# EasyEDA Pro project EKOPARTY_FINAL.eprj, schematic Schematic1
Board Name: Board1; Create Date: 2025-08-02; Page Name: P1; Project Name: EKOPARTY_FINAL; Schematic Name: Schematic1; Update Date: 2025-10-07; Company: EasyEDA.com; Drawn: Lucas Leal; Page Size: A4; Reviewed: Lucas Leal; Version: V1.0
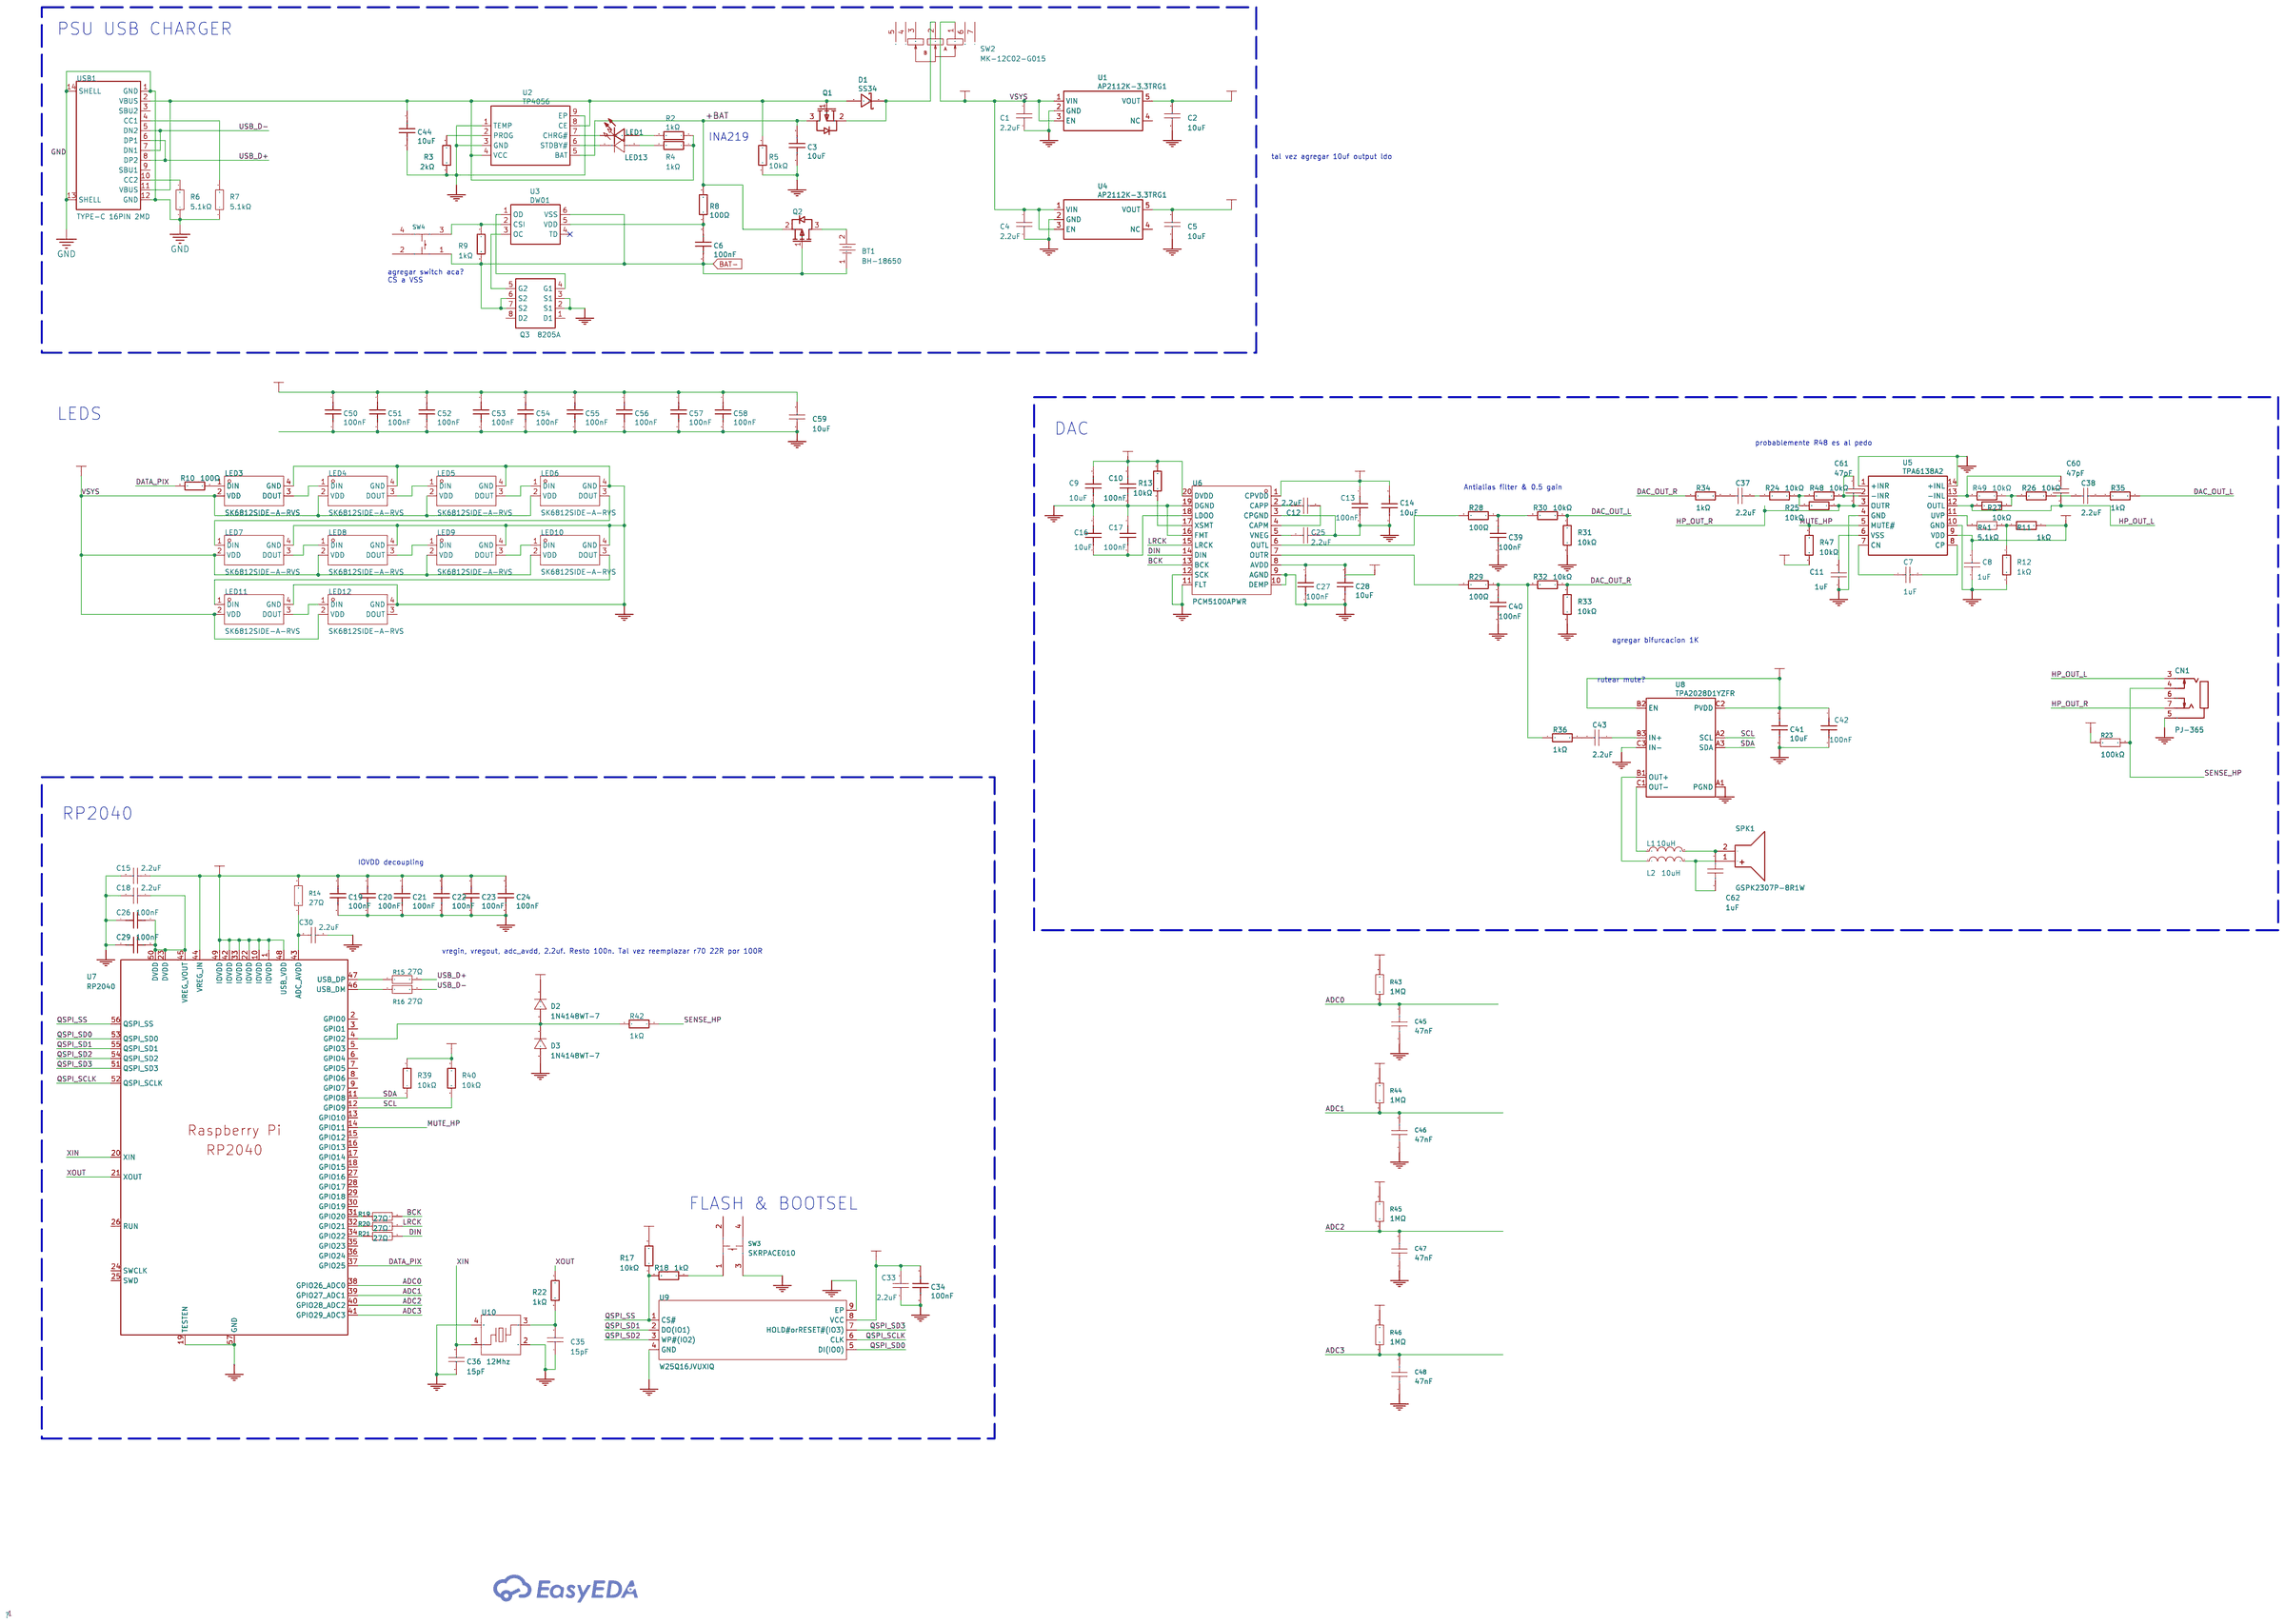
[diagram p0: schematic sheet]

## Parts
BT1  BH-18650  [BAT-TH_BH-18650-A1AJ005]
C1  2.2uF  [C0402]
C2  10uF  [C0402]
C3  10uF  [C0402]
C4  2.2uF  [C0402]
C5  10uF  [C0402]
C6  100nF  [C0402]
C7  1uF  [C0402]
C8  1uF  [C0402]
C9  10uF  [C0402]
C10  100nF  [C0402]
C11  1uF  [C0402]
C12  2.2uF  [C0402]
C13  100nF  [C0402]
C14  10uF  [C0402]
C15  2.2uF  [C0402]
C16  10uF  [C0402]
C17  100nF  [C0402]
C18  2.2uF  [C0402]
C19  100nF  [C0402]
C20  100nF  [C0402]
C21  100nF  [C0402]
C22  100nF  [C0402]
C23  100nF  [C0402]
C24  100nF  [C0402]
C25  2.2uF  [C0402]
C26  100nF  [C0402]
C27  100nF  [C0402]
C28  10uF  [C0402]
C29  100nF  [C0402]
C30  2.2uF  [C0402]
C33  2.2uF  [C0402]
C34  100nF  [C0402]
C35  15pF  [C0402]
C36  15pF  [C0402]
C37  2.2uF  [C0402]
C38  2.2uF  [C0402]
C39  100nF  [C0402]
C40  100nF  [C0402]
C41  10uF  [C0402]
C42  100nF  [C0402]
C43  2.2uF  [C0402]
C44  10uF  [C0402]
C45  47nF  [C0402]
C46  47nF  [C0402]
C47  47nF  [C0402]
C48  47nF  [C0402]
C50  100nF  [C0402]
C51  100nF  [C0402]
C52  100nF  [C0402]
C53  100nF  [C0402]
C54  100nF  [C0402]
C55  100nF  [C0402]
C56  100nF  [C0402]
C57  100nF  [C0402]
C58  100nF  [C0402]
C59  10uF  [C0402]
C60  47pF  [C0402]
C61  47pF  [C0402]
C62  1uF  [C0603]
CN1  PJ-365  [AUDIO-SMD_HOOYA_PJ-365]
D1  SS34  [SMA_L4.3-W2.6-LS5.2-RD]
D2  1N4148WT-7  [SOD-523_L1.2-W0.8-LS1.6-RD]
D3  1N4148WT-7  [SOD-523_L1.2-W0.8-LS1.6-RD]
L1  10uH  [L1206]
L2  10uH  [L1206]
LED1  KT-0603R  [LED0603-RD]
LED3  SK6812SIDE-A-RVS  [LED-SMD_4P-L4.0-W1.6-L]
LED4  SK6812SIDE-A-RVS  [LED-SMD_4P-L4.0-W1.6-L]
LED5  SK6812SIDE-A-RVS  [LED-SMD_4P-L4.0-W1.6-L]
LED6  SK6812SIDE-A-RVS  [LED-SMD_4P-L4.0-W1.6-L]
LED7  SK6812SIDE-A-RVS  [LED-SMD_4P-L4.0-W1.6-L]
LED8  SK6812SIDE-A-RVS  [LED-SMD_4P-L4.0-W1.6-L]
LED9  SK6812SIDE-A-RVS  [LED-SMD_4P-L4.0-W1.6-L]
LED10  SK6812SIDE-A-RVS  [LED-SMD_4P-L4.0-W1.6-L]
LED11  SK6812SIDE-A-RVS  [LED-SMD_4P-L4.0-W1.6-L]
LED12  SK6812SIDE-A-RVS  [LED-SMD_4P-L4.0-W1.6-L]
LED13  XL-1608UBC-04  [LED0603-RD_BLUE]
Q1  FDN340P  [SOT-23-3_L2.9-W1.3-P1.90-LS2.4-BR]
Q2  FDN340P  [SOT-23-3_L2.9-W1.3-P1.90-LS2.4-BR]
Q3  8205A  [TSSOP-8_L4.4-W3.0-P0.65-LS6.4-BL]
R2  1kΩ  [R0402]
R3  2kΩ  [R0402]
R4  1kΩ  [R0402]
R5  10kΩ  [R0402]
R6  5.1kΩ  [R0402]
R7  5.1kΩ  [R0402]
R8  100Ω  [R0402]
R9  1kΩ  [R0402]
R10  100Ω  [R0402]
R11  1kΩ  [R0402]
R12  1kΩ  [R0402]
R13  10kΩ  [R0402]
R14  27Ω  [R0402]
R15  27Ω  [R0402]
R16  27Ω  [R0402]
R17  10kΩ  [R0402]
R18  1kΩ  [R0402]
R19  27Ω  [R0402]
R20  27Ω  [R0402]
R21  27Ω  [R0402]
R22  1kΩ  [R0402]
R23  100kΩ  [R0402]
R24  10kΩ  [R0402]
R25  10kΩ  [R0402]
R26  10kΩ  [R0402]
R27  10kΩ  [R0402]
R28  100Ω  [R0402]
R29  100Ω  [R0402]
R30  10kΩ  [R0402]
R31  10kΩ  [R0402]
R32  10kΩ  [R0402]
R33  10kΩ  [R0402]
R34  1kΩ  [R0402]
R35  1kΩ  [R0402]
R36  1kΩ  [R0402]
R39  10kΩ  [R0402]
R40  10kΩ  [R0402]
R41  5.1kΩ  [R0402]
R42  1kΩ  [R0402]
R43  1MΩ  [R0402]
R44  1MΩ  [R0402]
R45  1MΩ  [R0402]
R46  1MΩ  [R0402]
R47  10kΩ  [R0402]
R48  10kΩ  [R0402]
R49  10kΩ  [R0402]
SPK1  GSPK2307P-8R1W  [SPK-TH_BD23.0-P10.00-D0.8-L-RD]
SW2  MK-12C02-G015  [SW-SMD_G-SWITCH_MK-12C02-G015]
SW3  SKRPACE010  [KEY-SMD_4P-L4.2-W3.2-P2.20-LS4.6]
SW4  SKRPACE010  [KEY-SMD_4P-L4.2-W3.2-P2.20-LS4.6]
U1  AP2112K-3.3TRG1  [SOT-25-5_L2.9-W1.6-P0.95-LS2.8-BL]
U2  TP4056  [ESOP-8_L4.9-W3.9-P1.27-LS6.0-BL-EP]
U3  DW01  [SOT-23-6_L2.9-W1.6-P0.95-LS2.8-BL]
U4  AP2112K-3.3TRG1  [SOT-25-5_L2.9-W1.6-P0.95-LS2.8-BL]
U5  TPA6138A2  [TSSOP-14_L5.0-W4.4-P0.65-LS6.4-BL]
U6  PCM5100APWR  [TSSOP-20_L6.5-W4.4-P0.65-LS6.4-BL]
U7  RP2040  [LQFN-56_L7.0-W7.0-P0.4-EP]
U8  TPA2028D1YZFR  [DSBGA-9_L1.6-W1.6-R3-C3-P0.50-BL]
U9  W25Q16JVUXIQ  [USON-8_L3.0-W2.0-P0.50-BL-EP]
U10  12Mhz  [CRYSTAL-SMD_4P-L3.2-W2.5-BL]
USB1  TYPE-C 16PIN 2MD  [USB-C-SMD_TYPE-C-6PIN-2MD-073]

## Library data of the parts
BT1 = BH-18650-A1AJ005: Connector Type:Battery box Battery Type:- Contact Plating:Nickel Operating Temperature Range:-10℃~+100℃ Operating Temperature Range:-10℃~+100℃; LCSC Part Name: 电池盒; Supplier Part: C5290176; Manufacturer: MYOUNG(美阳); JLCPCB Part Class: Extended Part; Datasheet: https://atta.szlcsc.com/upload/public/pdf/source/20221129/D0CEC1B107B5F52E469FD9B49033E00F.pdf; Supplier: LCSC; Connector Type: Battery box; Contact Plating: Nickel; Operating Temperature Range: -10℃~+100℃
C1 C4 C12 C15 C18 C25 C30 C33 C37 C38 C43 = CL05A225MQ5NSNC: Capacitance:2.2uF Tolerance:±20% Tolerance:±20% Voltage Rating:6.3V Temperature Coefficient:X5R; LCSC Part Name: 2.2uF ±20% 6.3V; Supplier Part: C12530; Manufacturer: SAMSUNG(三星); Supplier Footprint: 0402; JLCPCB Part Class: Basic Part; Datasheet: https://item.szlcsc.com/datasheet/CL05A225MQ5NSNC/13164.html; Supplier: LCSC; Tolerance: ±20%; Voltage Rating: 6.3V; Temperature Coefficient: X5R
C2 C3 C5 C9 C14 C16 C28 C41 C44 C59 = CL05A106MP5NUNC_C315248: Capacitance:10uF Tolerance:±20% Tolerance:±20% Voltage Rating:10V Temperature Coefficient:X5R; LCSC Part Name: 10uF ±20% 10V; Supplier Part: C315248; Manufacturer: SAMSUNG(三星); Manufacturer Part: CL05A106MP5NUNC; Supplier Footprint: 0402; JLCPCB Part Class: Extended Part; Datasheet: https://item.szlcsc.com/datasheet/CL05A106MP5NUNC/297154.html; Supplier: LCSC; Tolerance: ±20%; Voltage Rating: 10V; Temperature Coefficient: X5R
C6 C10 C13 C17 C19-C24 C26 C27 C29 C34 C39 C40 C42 C50-C58 = CC0402KRX7R7BB104: Capacitance: Tolerance:±10% Tolerance:±10% Voltage Rated: Temperature Coefficient:; LCSC Part Name: 100nF ±10% 16V; Supplier Part: C60474; Manufacturer: YAGEO(国巨); Supplier Footprint: 0402; JLCPCB Part Class: Extended Part; Datasheet: https://atta.szlcsc.com/upload/public/pdf/source/20211223/9278FD768280B81DDBEF48FA36411A03.pdf; Supplier: LCSC; Tolerance: ±10%
C7 C8 C11 = V105K0402X7R6R3NNT: Capacitance:1uF Voltage Rating:6.3V Temperature Coefficient:X7R; LCSC Part Name: 1uF 6.3V; Supplier Part: C5240378; Manufacturer: VIIYONG(微容); Supplier Footprint: 0402; JLCPCB Part Class: Extended Part; Datasheet: https://atta.szlcsc.com/upload/public/pdf/source/20221028/4C264D2A4471DD50C489C4512F376FF6.pdf; Supplier: LCSC; Voltage Rating: 6.3V; Temperature Coefficient: X7R
C35 C36 = 0402CG150J500NT: LCSC Part Name: 15pF ±5% 50V; Supplier Part: C1548; Manufacturer: FH(风华); Supplier Footprint: 0402; JLCPCB Part Class: Basic Part; Datasheet: https://atta.szlcsc.com/upload/public/pdf/source/20200305/C486355_26A10D38EF8C2A5C37091D0039909270.pdf; Supplier: LCSC; Tolerance: ±5%
C45-C48 = TCC0402X7R473K500AT: LCSC Part Name: 47nF ±10% 50V; Supplier Part: C880605; Manufacturer: CCTC(三环); Supplier Footprint: 0402; JLCPCB Part Class: Extended Part; Datasheet: https://atta.szlcsc.com/upload/public/pdf/source/20200707/C696841_89A2C111301AB76AE7642008585E7A11.pdf; Supplier: LCSC; Tolerance: ±10%
C60 C61 = 0402CG470J500NT: LCSC Part Name: 47pF ±5% 50V; Supplier Part: C1567; Manufacturer: FH(风华); Supplier Footprint: 0402; JLCPCB Part Class: Basic Part; Datasheet: https://atta.szlcsc.com/upload/public/pdf/source/20200305/C486355_26A10D38EF8C2A5C37091D0039909270.pdf; Supplier: LCSC; Tolerance: ±5%; Voltage Rating: 50V; Temperature Coefficient: C0G
C62 = CL10A105KB8NNNC: LCSC Part Name: 1uF ±10% 50V; Supplier Part: C15849; Manufacturer: SAMSUNG(三星); Supplier Footprint: 0603; JLCPCB Part Class: Basic Part; Datasheet: https://item.szlcsc.com/datasheet/CL10A105KB8NNNC/16531.html; Supplier: LCSC; Tolerance: ±10%; Voltage Rating: 50V; Temperature Coefficient: X5R
CN1 = PJ-365: Supplier: LCSC; Supplier Part: C2939161; Manufacturer: HOOYA(皓宇电子); JLCPCB Part Class: Extended Part; Contributor: LCSC; spicePre: C
D1 = SS34: Supplier: LCSC; Manufacturer: MDD; Supplier Part: C8678; JLCPCB Part Class: Basic Part; spicePre: D; spiceSymbolName: SS34_C8678
D2 D3 = 1N4148WT-7_C83482: Supplier Part: C83482; Manufacturer: DIODES(美台); Supplier Footprint: SOD-523; JLCPCB Part Class: Extended Part; Datasheet: https://item.szlcsc.com/datasheet/1N4148WT-7/84647.html; Supplier: LCSC; Diode Configuration: Independent; Voltage - Forward(Vf@If): 1.25V@150mA; Voltage - DC Reverse(Vr): 80V; Current - Rectified: 125mA; Pd - Power Dissipation: 150mW; Reverse Leakage Current (Ir): 1uA@75V; Reverse Recovery Time (trr): 4ns; Operating Junction Temperature Range: -65℃~+150℃@(Tj); Non-Repetitive Peak Forward Surge Current: 2A
L1 L2 = MGFL3216F100MT-LF: LCSC Part Name: 10uH ±20%; Supplier Part: C281117; Manufacturer: microgate(麦捷科技); Supplier Footprint: 1206; JLCPCB Part Class: Extended Part; Datasheet: https://item.szlcsc.com/datasheet/MGFL3216F100MT-LF/267450.html; Supplier: LCSC; Tolerance: ±20%; Current Rating: 670mA; DC Resistance(DCR): 500mΩ
LED1 = KT-0603R: Supplier: LCSC; Manufacturer: KENTO; Supplier Part: C2286; JLCPCB Part Class: Basic Part; spicePre: L
LED3-LED12 = SK6812SIDE-A-RVS: LCSC Part Name: RGB三色; Supplier Part: C2890037; Manufacturer: 欧思科光电; Supplier Footprint: SMD,2x4mm; JLCPCB Part Class: Extended Part; Datasheet: https://atta.szlcsc.com/upload/public/pdf/source/20210825/5EE39C41748E35606331A2C5A4C913B6.pdf; Supplier: LCSC
LED13 = XL-1608UBC-04: Supplier Part: C965807; Manufacturer: XINGLIGHT(成兴光); Supplier Footprint: 0603; JLCPCB Part Class: Extended Part; Datasheet: https://item.szlcsc.com/datasheet/XL-1608UBC-04/1051416.html; Supplier: LCSC; Illumination Color: Blue; Voltage - Forward(Vf): 3.3V; Power(Watts): 70mW; Forward Current: 20mA; Wavelength - Dominant: 455nm~475nm; Peak Wavelength: 470nm; Lens Color: Water Clear; Luminous Intensity: 300mcd; Viewing Angle: 120°; Mounting Style: op View Mount
Q1 Q2 = FDN340P: Supplier Part: C2890122; Manufacturer: TECH PUBLIC(台舟); Supplier Footprint: SOT-23; JLCPCB Part Class: Extended Part; Datasheet: https://atta.szlcsc.com/upload/public/pdf/source/20210903/3458D4EFB17228716B6B26FC4AFCE66E.pdf; Supplier: LCSC
Q3 = 8205A: Supplier: LCSC; Supplier Part: C7499846; Manufacturer: HL(富海微); JLCPCB Part Class: Extended Part; Contributor: lcsc; spicePre: Q; spiceSymbolName: 8205A_C7499846
R2 R4 R9 R11 R12 R18 R22 R34-R36 R42 = 0402WGF1001TCE: Type:Thick Film Resistors Resistance:1kΩ Tolerance:±1% Tolerance:±1% Power(Watts): Overload Voltage (Max): Temperature Coefficient:±100ppm/℃ Temperature Coefficient:±100ppm/℃ Operating Temperature Range:-55℃~+155℃ Operating Temperature Range:-55℃~+155℃; LCSC Part Name: 1kΩ ±1% 62.5mW 厚膜电阻; Supplier Part: C11702; Manufacturer: UNI-ROYAL(厚声); Supplier Footprint: 0402; JLCPCB Part Class: Basic Part; Datasheet: https://atta.szlcsc.com/upload/public/pdf/source/20200306/C422600_1E6D84923E4A46A82E41ADD87F860B5C.pdf; Supplier: LCSC; Type: Thick Film Resistors; Tolerance: ±1%; Temperature Coefficient: ±100ppm/℃; Operating Temperature Range: -55℃~+155℃
R3 = 0402WGF2001TCE: Type:Thick Film Resistors Resistance:2kΩ Tolerance:±1% Tolerance:±1% Power(Watts): Overload Voltage (Max): Temperature Coefficient:±100ppm/℃ Temperature Coefficient:±100ppm/℃ Operating Temperature Range:-55℃~+155℃ Operating Temperature Range:-55℃~+155℃; LCSC Part Name: 2kΩ ±1% 62.5mW 厚膜电阻; Supplier Part: C4109; Manufacturer: UNI-ROYAL(厚声); Supplier Footprint: 0402; JLCPCB Part Class: Basic Part; Datasheet: https://atta.szlcsc.com/upload/public/pdf/source/20200306/C422600_1E6D84923E4A46A82E41ADD87F860B5C.pdf; Supplier: LCSC; Type: Thick Film Resistors; Tolerance: ±1%; Temperature Coefficient: ±100ppm/℃; Operating Temperature Range: -55℃~+155℃
R5 R13 R17 R24-R27 R30-R33 R39 R40 R47-R49 = 0402WGF1002TCE: Type:Thick Film Resistors Resistance:10kΩ Tolerance:±1% Tolerance:±1% Power(Watts): Overload Voltage (Max): Temperature Coefficient:±100ppm/℃ Temperature Coefficient:±100ppm/℃ Operating Temperature Range:-55℃~+155℃ Operating Temperature Range:-55℃~+155℃; LCSC Part Name: 10kΩ ±1% 62.5mW 厚膜电阻; Supplier Part: C25744; Manufacturer: UNI-ROYAL(厚声); Supplier Footprint: 0402; JLCPCB Part Class: Basic Part; Datasheet: https://atta.szlcsc.com/upload/public/pdf/source/20200306/C422600_1E6D84923E4A46A82E41ADD87F860B5C.pdf; Supplier: LCSC; Type: Thick Film Resistors; Tolerance: ±1%; Temperature Coefficient: ±100ppm/℃; Operating Temperature Range: -55℃~+155℃
R6 R7 R41 = 0402WGF5101TCE: Type:Thick Film Resistor Resistance:5.1kΩ Tolerance:±1% Tolerance:±1% Power(Watts):62.5mW Voltage-Supply(Max):50V Temperature Coefficient:±100ppm/℃ Temperature Coefficient:±100ppm/℃ Operating Temperature:-55℃~+155℃ Operating Temperature:-55℃~+155℃; LCSC Part Name: 5.1kΩ ±1% 62.5mW 厚膜电阻; Supplier Part: C25905; Manufacturer: UNI-ROYAL(厚声); Supplier Footprint: 0402; JLCPCB Part Class: Basic Part; Datasheet: https://atta.szlcsc.com/upload/public/pdf/source/20200306/C422600_1E6D84923E4A46A82E41ADD87F860B5C.pdf; Supplier: LCSC; Type: Thick Film Resistor; Tolerance: ±1%; Power(Watts): 62.5mW; Voltage-Supply(Max): 50V; Temperature Coefficient: ±100ppm/℃; Operating Temperature: -55℃~+155℃
R8 R10 R28 R29 = 0402WGF1000TCE: Type:Thick Film Resistors Resistance: Tolerance:±1% Tolerance:±1% Power(Watts): Overload Voltage (Max): Temperature Coefficient:±200ppm/℃ Temperature Coefficient:±200ppm/℃ Operating Temperature Range:-55℃~+155℃ Operating Temperature Range:-55℃~+155℃; LCSC Part Name: 100Ω ±1% 62.5mW 厚膜电阻; Supplier Part: C25076; Manufacturer: UNI-ROYAL(厚声); Supplier Footprint: 0402; JLCPCB Part Class: Basic Part; Datasheet: https://atta.szlcsc.com/upload/public/pdf/source/20200306/C422600_1E6D84923E4A46A82E41ADD87F860B5C.pdf; Supplier: LCSC; Type: Thick Film Resistors; Tolerance: ±1%; Temperature Coefficient: ±200ppm/℃; Operating Temperature Range: -55℃~+155℃
R14-R16 R19-R21 = RC0402FR-0727RL: Type:Thick Film Resistor Resistance:27Ω Tolerance:±1% Tolerance:±1% Power(Watts):62.5mW Voltage-Supply(Max):50V Temperature Coefficient:±100ppm/℃ Temperature Coefficient:±100ppm/℃ Operating Temperature:-55℃~+155℃ Operating Temperature:-55℃~+155℃; LCSC Part Name: 厚膜电阻 27Ω ±1% 62.5mW; Supplier Part: C138021; Manufacturer: YAGEO(国巨); Supplier Footprint: 0402; JLCPCB Part Class: Extended Part; Datasheet: https://item.szlcsc.com/datasheet/RC0402FR-0727RL/149337.html; Supplier: LCSC; Type: Thick Film Resistor; Tolerance: ±1%; Power(Watts): 62.5mW; Voltage-Supply(Max): 50V; Temperature Coefficient: ±100ppm/℃; Operating Temperature: -55℃~+155℃
R23 = 0402WGJ0104TCE: Type:Thick Film Resistor Resistance:100kΩ Tolerance:±5% Tolerance:±5% Power(Watts):62.5mW Voltage-Supply(Max):50V Temperature Coefficient:±100ppm/℃ Temperature Coefficient:±100ppm/℃ Operating Temperature:-55℃~+155℃ Operating Temperature:-55℃~+155℃; LCSC Part Name: 100kΩ ±5% 62.5mW 厚膜电阻; Supplier Part: C25530; Manufacturer: UNI-ROYAL(厚声); Supplier Footprint: 0402; JLCPCB Part Class: Extended Part; Datasheet: https://item.szlcsc.com/datasheet/0402WGJ0104TCE/26273.html; Supplier: LCSC; Type: Thick Film Resistor; Tolerance: ±5%; Power(Watts): 62.5mW; Voltage-Supply(Max): 50V; Temperature Coefficient: ±100ppm/℃; Operating Temperature: -55℃~+155℃
R43-R46 = 0402WGF1004TCE: LCSC Part Name: 1MΩ ±1% 62.5mW 厚膜电阻; Supplier Part: C26083; Manufacturer: UNI-ROYAL(厚声); Supplier Footprint: 0402; JLCPCB Part Class: Basic Part; Datasheet: https://atta.szlcsc.com/upload/public/pdf/source/20200306/C422600_1E6D84923E4A46A82E41ADD87F860B5C.pdf; Supplier: LCSC; Type: Thick Film Resistors; Tolerance: ±1%; Temperature Coefficient: ±100ppm/℃; Operating Temperature Range: -55℃~+155℃
SPK1 = GSPK2307P-8R1W: Supplier: LCSC; Supplier Part: C530531; Manufacturer: INGHAi(赢海); JLCPCB Part Class: Extended Part; Contributor: LCSC; spicePre: S
SW2 = MK-12C02-G015_C2911519: LCSC Part Name: 七脚贴片微型拨动开关 G1.5; Supplier Part: C2911519; Manufacturer: G-Switch(品赞); Supplier Footprint: SMD; JLCPCB Part Class: Extended Part; Datasheet: https://atta.szlcsc.com/upload/public/pdf/source/20200902/C778186_2AF08473ED98414D93A175E8814EEFA6.pdf; Supplier: LCSC; Circuit: SPDT; Actuator Style: Rectangular columnar; Pin Style: SMDSplicing; Switch Length: 6.6mm; Switch Width: 2.7mm; Switch Height: 4.2mm; Mounting Style: 卧贴; Actuator Color: Black; Current Rating (DC): 1A; Voltage Rating (DC): 6V; Mechanical Life: 1万次; Operating Temperature: -20℃~+70℃
SW3 SW4 = SKRPACE010: LCSC Part Name: 4.2*3.2*2.5mm 立贴 轻触开关; Supplier Part: C139797; Manufacturer: ALPSALPINE(阿尔卑斯阿尔派); Supplier Footprint: SMD; JLCPCB Part Class: Extended Part; Datasheet: https://atta.szlcsc.com/upload/public/pdf/source/20171113/C139797_15105612676371115729.pdf; Supplier: LCSC; Circuit: SPST; Actuator Style: Oval button; Mounting Style: Brick nogging; Switch Length: 4.2mm; Switch Width: 3.2mm; Switch Height: 2.5mm; Contact Current: 50mA; Voltage Rating (DC): 16V
U1 U4 = AP2112K-3.3TRG1: Supplier: LCSC; Manufacturer: DIODES(美台); Supplier Part: C51118; JLCPCB Part Class: Extended Part; Contributor: LCSC; spicePre: U
U2 = TP4056: Supplier: LCSC; Supplier Part: C725790; Manufacturer: UMW(友台半导体); JLCPCB Part Class: Extended Part; Contributor: LCSC; spicePre: U; spiceSymbolName: TP4056_C725790
U3 = DW01: Supplier: LCSC; Supplier Part: C917079; Manufacturer: JSMSEMI(杰盛微); JLCPCB Part Class: Extended Part; Contributor: LCSC; spicePre: U; spiceSymbolName: DW01_C917079
U5 = TPA6138A2PWR: Supplier: LCSC; Supplier Part: C183097; Manufacturer: TI(德州仪器); JLCPCB Part Class: Extended Part; Contributor: LCSC; spicePre: U
U6 = PCM5100APWR: LCSC Part Name: 具有PLL和32位、384kHz PCM接口的音频立体声DAC; Supplier Part: C131154; Manufacturer: TI(德州仪器); Supplier Footprint: TSSOP-20; JLCPCB Part Class: Extended Part; Datasheet: https://www.ti.com/cn/lit/gpn/pcm5102a; Supplier: LCSC; Voltage - Supply: 1.8V~3.3V; Interface Type: I2S
U7 = RP2040: Supplier: LCSC; Supplier Part: C2040; Manufacturer: Raspberry Pi(树莓派); JLCPCB Part Class: Extended Part; Contributor: LCSC; spicePre: U
U8 = TPA2028D1YZFR: Supplier: LCSC; Supplier Part: C2869063; Manufacturer: TI(德州仪器); JLCPCB Part Class: Extended Part; Contributor: lcsc; spicePre: U
U9 = W25Q16JVUXIQ: Supplier Part: C2843335; Manufacturer: Winbond(华邦); Supplier Footprint: USON-8-EP(2x3); JLCPCB Part Class: Extended Part; Datasheet: https://atta.szlcsc.com/upload/public/pdf/source/20210629/C2843335_FB4D78B5076715625DC0C83F790D3044.pdf; Supplier: LCSC; Interface: SPI; Memory Size: 16Mbit; Clock Frequency: 133MHz; Voltage - Supply: 2.7V~3.6V; Program / Erase Cycles: 100,000 Cycles; Page Programming Time (Tpp): 3ms; Data Retention - TDR (Year): 20 Years
U10 = ABM8-272-T3_C20625731: LCSC Part Name: ABM8-272-T3; Supplier Part: C20625731; Manufacturer: ABRACON; Supplier Footprint: SMD3225-4P; JLCPCB Part Class: Extended Part; Datasheet: https://atta.szlcsc.com/upload/public/pdf/source/20240227/A8BE43F636D80F75C9AF5C59EDF21E9A.pdf; Supplier: LCSC
USB1 = TYPE-C 16PIN 2MD(073): Supplier: LCSC; Supplier Part: C2765186; Manufacturer: SHOU HAN(首韩); JLCPCB Part Class: Extended Part; Contributor: LCSC; spicePre: U

## Nets
3.3V: C2.1 C9.2 C10.1 C13.1 C14.2 C15.1 C19.1 C20.1 C21.1 C22.1 C23.1 C24.1 C33.1 C34.1 D2.1(K) R13.2 R14.2 R17.2 R23.2 R39.2 R40.1 R43.2 R44.2 R45.2 R46.2 R47.2 U1.5(VOUT) U6.1(CPVDD) U6.20(DVDD) U7.1(IOVDD) U7.10(IOVDD) U7.22(IOVDD) U7.33(IOVDD) U7.42(IOVDD) U7.44(VREG_IN) U7.48(USB_VDD) U7.49(IOVDD) U9.8(VCC)
3.3VA: C5.1 C8.2 C27.1 C28.2 C41.2 C42.1 R11.1 U4.5(VOUT) U5.9(VDD) U6.8(AVDD) U8.B2(EN) U8.C2(PVDD)
GND: C1.2 C2.2 C3.1 C4.2 C5.2 C8.1 C9.1 C10.2 C11.1 C13.2 C14.1 C15.2 C16.2 C17.1 C18.2 C19.2 C20.2 C21.2 C22.2 C23.2 C24.2 C25.2 C26.1 C27.2 C28.1 C29.1 C30.1 C33.2 C34.2 C35.1 C36.1 C39.2 C40.2 C41.1 C42.2 C44.2 C45.1 C46.1 C47.1 C48.1 C50.2 C51.2 C52.2 C53.2 C54.2 C55.2 C56.2 C57.2 C58.2 C59.2 CN1.5 D3.2(A) LED3.4(GND) LED4.4(GND) LED5.4(GND) LED6.4(GND) LED7.4(GND) LED8.4(GND) LED9.4(GND) LED10.4(GND) LED11.4(GND) LED12.4(GND) Q3.2(S1) Q3.3(S1) R3.1 R5.1 R6.1 R7.1 R12.2 R31.2 R33.2 SW3.3 U1.2(GND) U2.1(TEMP) U2.3(GND) U2.9(EP) U4.2(GND) U5.1(+INR) U5.4(GND) U5.10(GND) U5.14(+INL) U6.3(CPGND) U6.9(AGND) U6.10(DEMP) U6.11(FLT) U6.12(SCK) U6.16(FMT) U6.19(DGND) U7.19(TESTEN) U7.57(GND) U8.A1(PGND) U8.C3(IN-) U9.4(GND) U9.9(EP) U10.2(GND) U10.4(GND) USB1.1(GND) USB1.12(GND) USB1.13(SHELL) USB1.14(SHELL)
+BAT: C3.2 Q1.3(D) Q2.2(S) R8.2 U2.5(BAT)
ADC0: C45.2 R43.1 U7.38(GPIO26_ADC0)
ADC1: C46.2 R44.1 U7.39(GPIO27_ADC1)
ADC2: C47.2 R45.1 U7.40(GPIO28_ADC2)
ADC3: C48.2 R46.1 U7.41(GPIO29_ADC3)
BAT-: BT1.1 C6.2 Q2.1(G) Q3.6(S2) Q3.7(S2) R9.2 SW4.1 U3.6(VSS)
BCK: R19.2 U6.13(BCK)
DAC_OUT_L: R30.1 R31.1 R35.2
DAC_OUT_R: R32.1 R33.1 R34.1
DATA_PIX: R10.2 U7.37(GPIO25)
DIN: R21.2 U6.14(DIN)
HP_OUT_L: C60.1 CN1.3 R27.2 U5.12(OUTL)
HP_OUT_R: C61.1 CN1.7 R25.1 U5.3(OUTR)
LRCK: R20.2 U6.15(LRCK)
MUTE_HP: R47.1 U5.5(MUTE#) U7.14(GPIO11)
QSPI_SCLK: U7.52(QSPI_SCLK) U9.6(CLK)
QSPI_SD0: U7.53(QSPI_SD0) U9.5(DI(IO0))
QSPI_SD1: U7.55(QSPI_SD1) U9.2(DO(IO1))
QSPI_SD2: U7.54(QSPI_SD2) U9.3(WP#(IO2))
QSPI_SD3: U7.51(QSPI_SD3) U9.7(HOLD#orRESET#(IO3))
QSPI_SS: R17.1 R18.2 U7.56(QSPI_SS) U9.1(CS#)
SCL: R40.2 U7.12(GPIO9) U8.A2(SCL)
SDA: R39.1 U7.11(GPIO8) U8.A3(SDA)
SENSE_HP: CN1.4 R23.1 R42.2
USB_D+: R15.2 USB1.6(DP1) USB1.8(DP2)
USB_D-: R16.2 USB1.5(DN2) USB1.7(DN1)
VSYS: C1.1 C4.1 C50.1 C51.1 C52.1 C53.1 C54.1 C55.1 C56.1 C57.1 C58.1 C59.1 LED3.2(VDD) LED4.2(VDD) LED5.2(VDD) LED6.2(VDD) LED7.2(VDD) LED8.2(VDD) LED9.2(VDD) LED10.2(VDD) LED11.2(VDD) LED12.2(VDD) SW2.1 U1.1(VIN) U1.3(EN) U4.1(VIN) U4.3(EN)
XIN: C36.2 U7.20(XIN) U10.1
XOUT: R22.1 U7.21(XOUT)
$1N2546: Q3.4(G1) U3.1(OD)
$1N2547: Q3.5(G2) U3.3(OC)
$1N2549: R9.1 SW4.3 U3.2(CSI)
$1N2552: C6.1 R8.1 U3.5(VDD)
$1N2554: C44.1 D1.2(A) Q1.1(G) R2.1 R4.1 R5.2 U2.4(VCC) U2.8(CE) USB1.2(VBUS) USB1.11(VBUS)
$1N2555: LED13.2(A) R4.2
$1N2556: LED1.2(A) R2.2
$1N2557: LED13.1(K) U2.6(STDBY#)
$1N2558: LED1.1(K) U2.7(CHRG#)
$1N2560: R3.2 U2.2(PROG)
$1N4366: R6.2 USB1.10(CC2)
$1N4379: R7.2 USB1.4(CC1)
$1N5069: C35.2 R22.2 U10.3
$1N5247: R15.1 U7.47(USB_DP)
$1N5251: R16.1 U7.46(USB_DM)
$1N5714: C18.1 C26.2 C29.2 U7.23(DVDD) U7.45(VREG_VOUT) U7.50(DVDD)
$1N5982: C30.2 R14.1 U7.43(ADC_AVDD)
$1N6481: R18.1 SW3.1
$1N6520: LED3.3(DOUT) LED4.1(DIN)
$1N6526: LED4.3(DOUT) LED5.1(DIN)
$1N6533: LED5.3(DOUT) LED6.1(DIN)
$1N6540: LED6.3(DOUT) LED7.1(DIN)
$1N6546: LED7.3(DOUT) LED8.1(DIN)
$1N6553: LED8.3(DOUT) LED9.1(DIN)
$1N6560: LED9.3(DOUT) LED10.1(DIN)
$1N6566: LED10.3(DOUT) LED11.1(DIN)
$1N6572: LED11.3(DOUT) LED12.1(DIN)
$1N6927: C12.1 U6.2(CAPP)
$1N6981: C25.1 U6.5(VNEG)
$1N7021: C12.2 U6.4(CAPM)
$1N7276: C16.1 C17.2 U6.18(LDOO)
$1N7511: R29.2 U6.7(OUTR)
$1N7565: R13.1 U6.17(XSMT)
$1N7694: R19.1 U7.31(GPIO20)
$1N7745: R20.1 U7.32(GPIO21)
$1N7820: R21.1 U7.34(GPIO22)
$1N7980: C7.1 U5.7(CN)
$1N7985: C7.2 U5.8(CP)
$1N8059: C11.2 U5.6(VSS)
$1N8912: LED3.1(DIN) R10.1
$1N9113: BT1.2 Q2.3(D)
$1N11147: R28.2 U6.6(OUTL)
$1N11253: C37.1 R24.2
$1N11485: C38.2 R26.1
$1N11610: C39.1 R28.1 R30.2
$1N11709: C40.1 R29.1 R32.2 R36.1
$1N12142: C43.1 U8.B3(IN+)
$1N12188: L1.1 U8.C1(OUT-)
$1N12193: L2.1 U8.B1(OUT+)
$1N21898: C37.2 R34.2
$1N21938: C38.1 R35.1
$1N21976: C43.2 R36.2
$1N22177: R26.2 R27.1 R49.1
$1N22211: R24.1 R25.2 R48.2
$1N22282: R41.2 U5.11(UVP)
$1N22285: R11.2 R12.1 R41.1
$1N22489: D2.2(A) D3.1(K) R42.1 U7.4(GPIO2)
$1N22838: D1.1(K) Q1.2(S) SW2.2
$1N27929: C61.2 R48.1 U5.2(-INR)
$1N27982: C60.2 R49.2 U5.13(-INL)
$1N35424: C62.2 L1.2 SPK1.2(-)
$1N35429: C62.1 L2.2 SPK1.1(+)

Not connected (* = marked no-connect by the designer): CN1 6; LED12 3(DOUT); Q3 1(D1) 8(D2); SW2 3 4 5 6 7; SW3 2 4; SW4 2 4; U1 4(NC); U3 4(TD)*; U4 4(NC); U7 2(GPIO0) 3(GPIO1) 5(GPIO3) 6(GPIO4) 7(GPIO5) 8(GPIO6) 9(GPIO7) 13(GPIO10) 15(GPIO12) 16(GPIO13) 17(GPIO14) 18(GPIO15) 24(SWCLK) 25(SWD) 26(RUN) 27(GPIO16) 28(GPIO17) 29(GPIO18) 30(GPIO19) 35(GPIO23) 36(GPIO24); USB1 3(SBU2) 9(SBU1)

## Notes on the sheet
- PSU USB CHARGER
- INA219
- tal vez agregar 10uf output ldo
- agregar switch aca?
  CS a VSS
- LEDS
- DAC
- probablemente R48 es al pedo
- Antialias filter & 0.5 gain
- agregar bifurcacion 1K
- rutear mute?
- RP2040
- IOVDD decoupling
- vregin, vregout, adc_avdd, 2.2uf. Resto 100n. Tal vez reemplazar r70 22R por 100R
- FLASH & BOOTSEL
